# EAGLE schematic BMS-HVver3 (EAGLE 6.6.0)
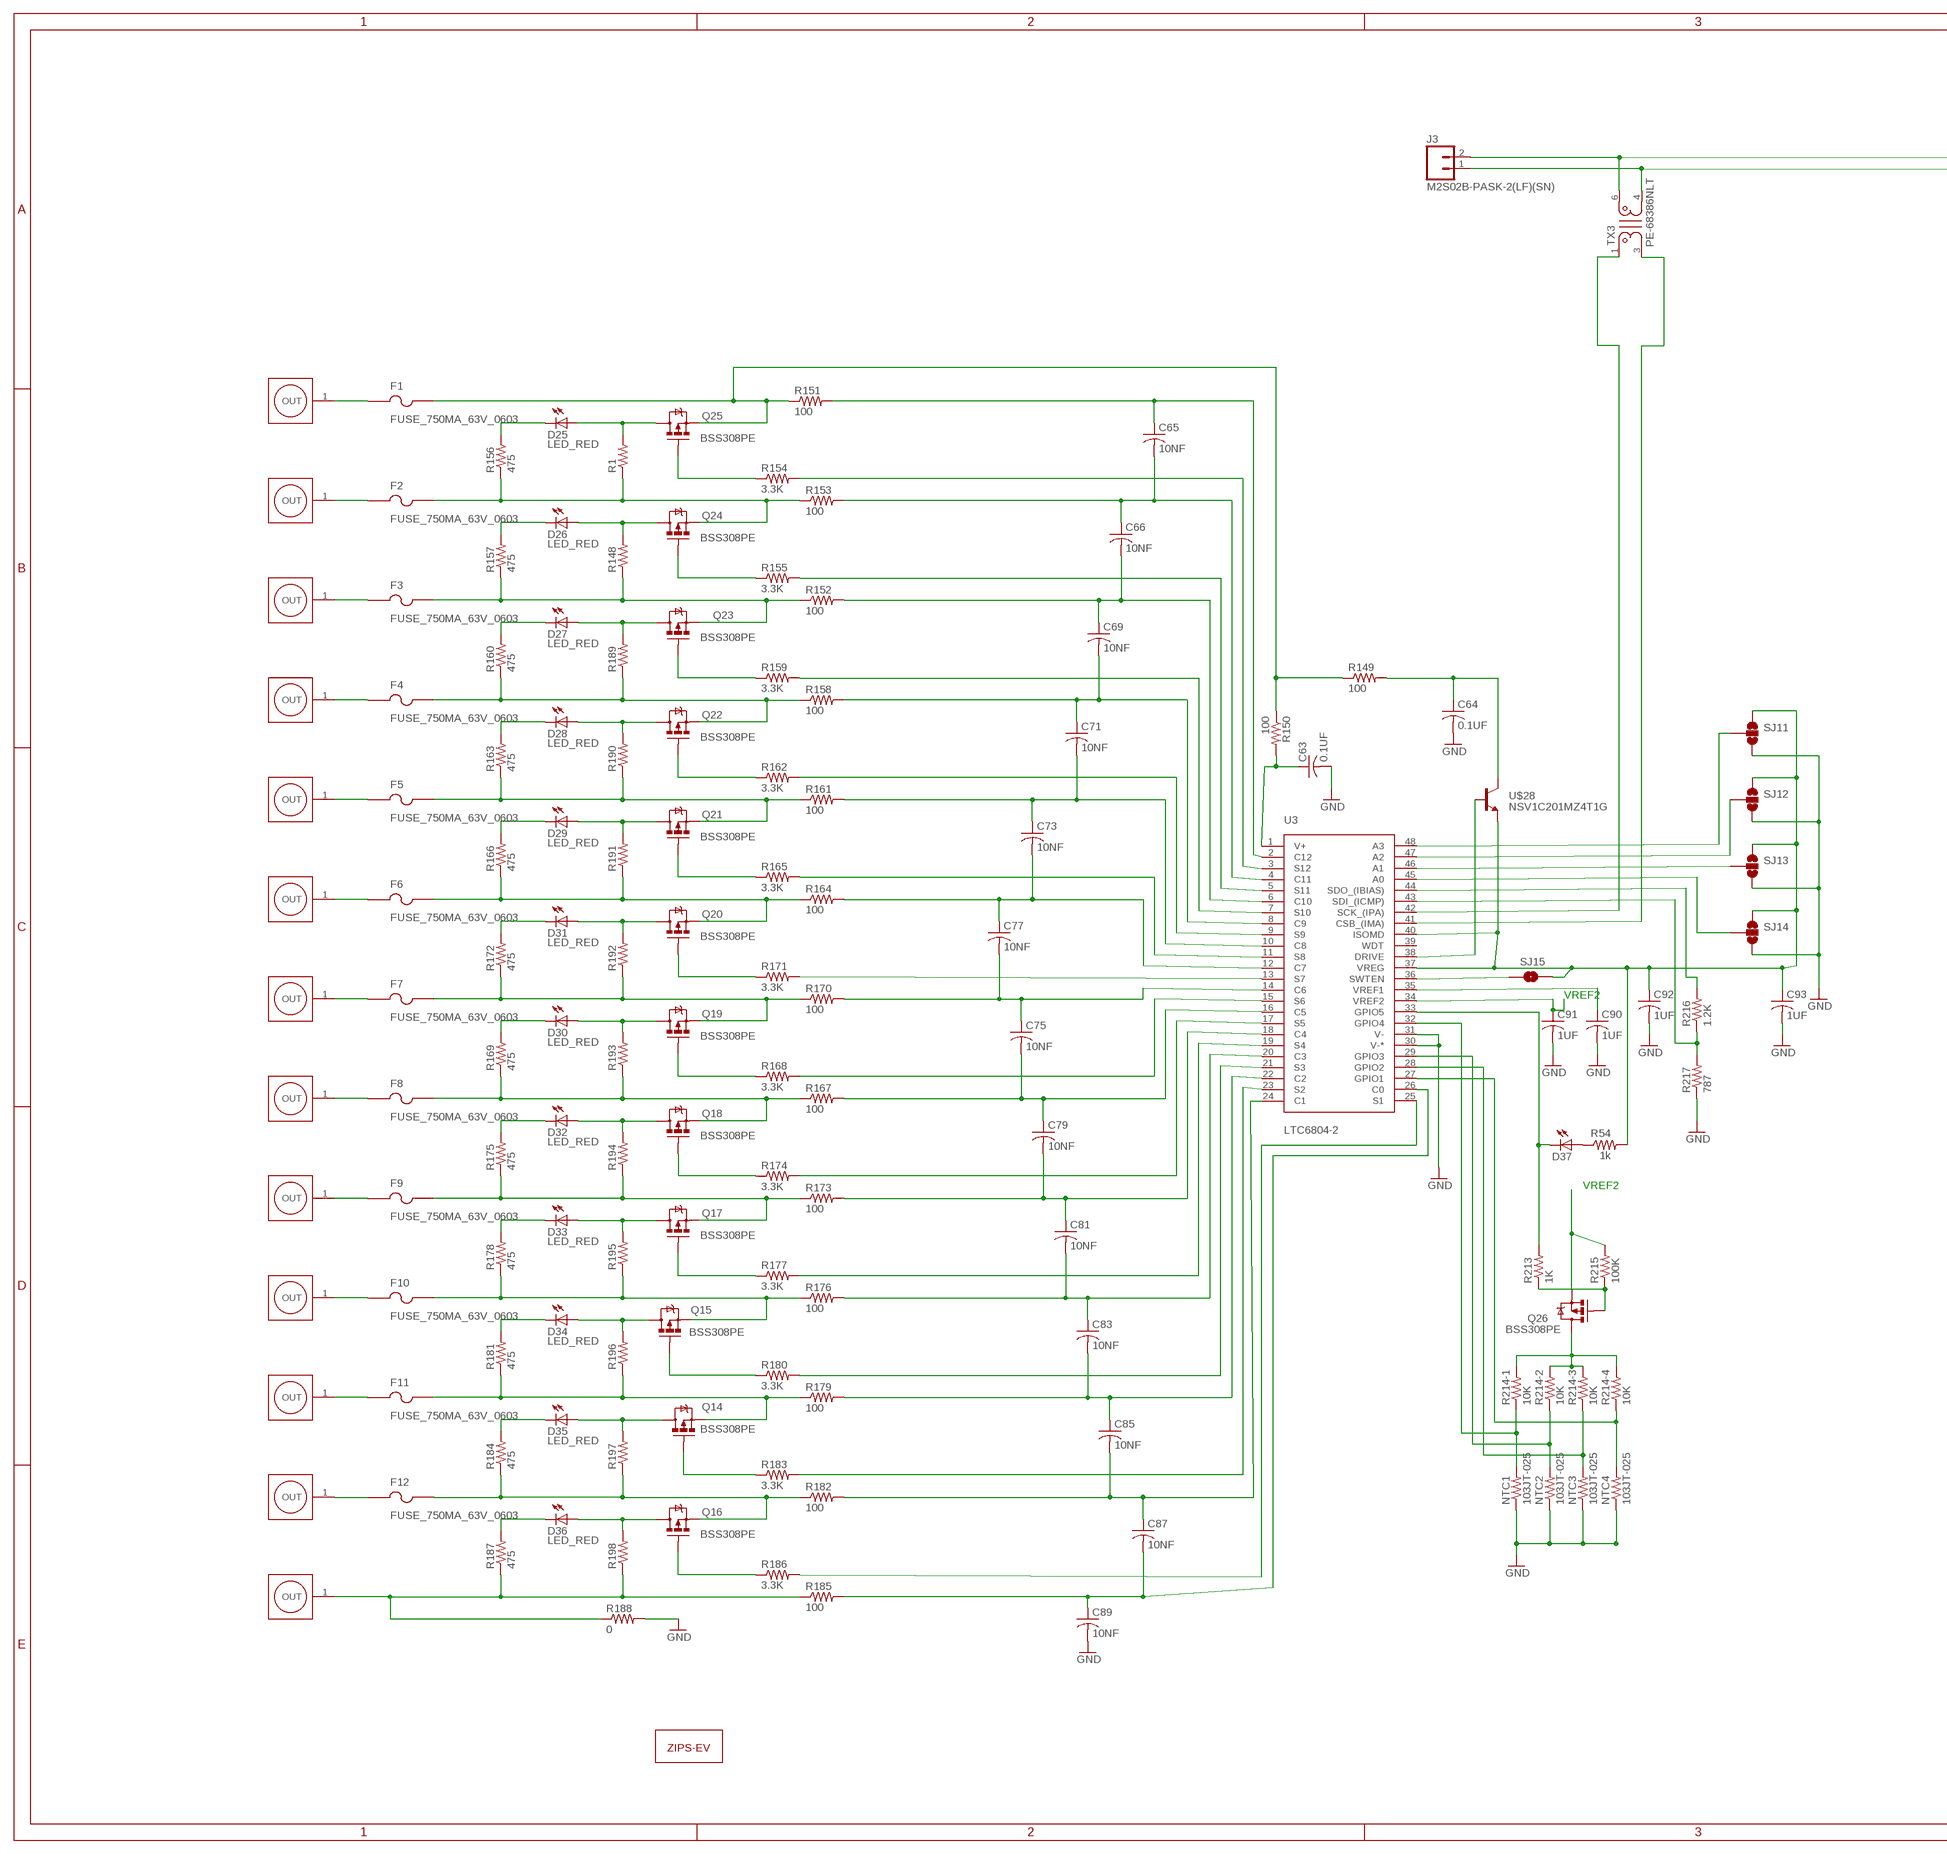
[diagram p0: schematic, sheet 1, part 1 of 3]
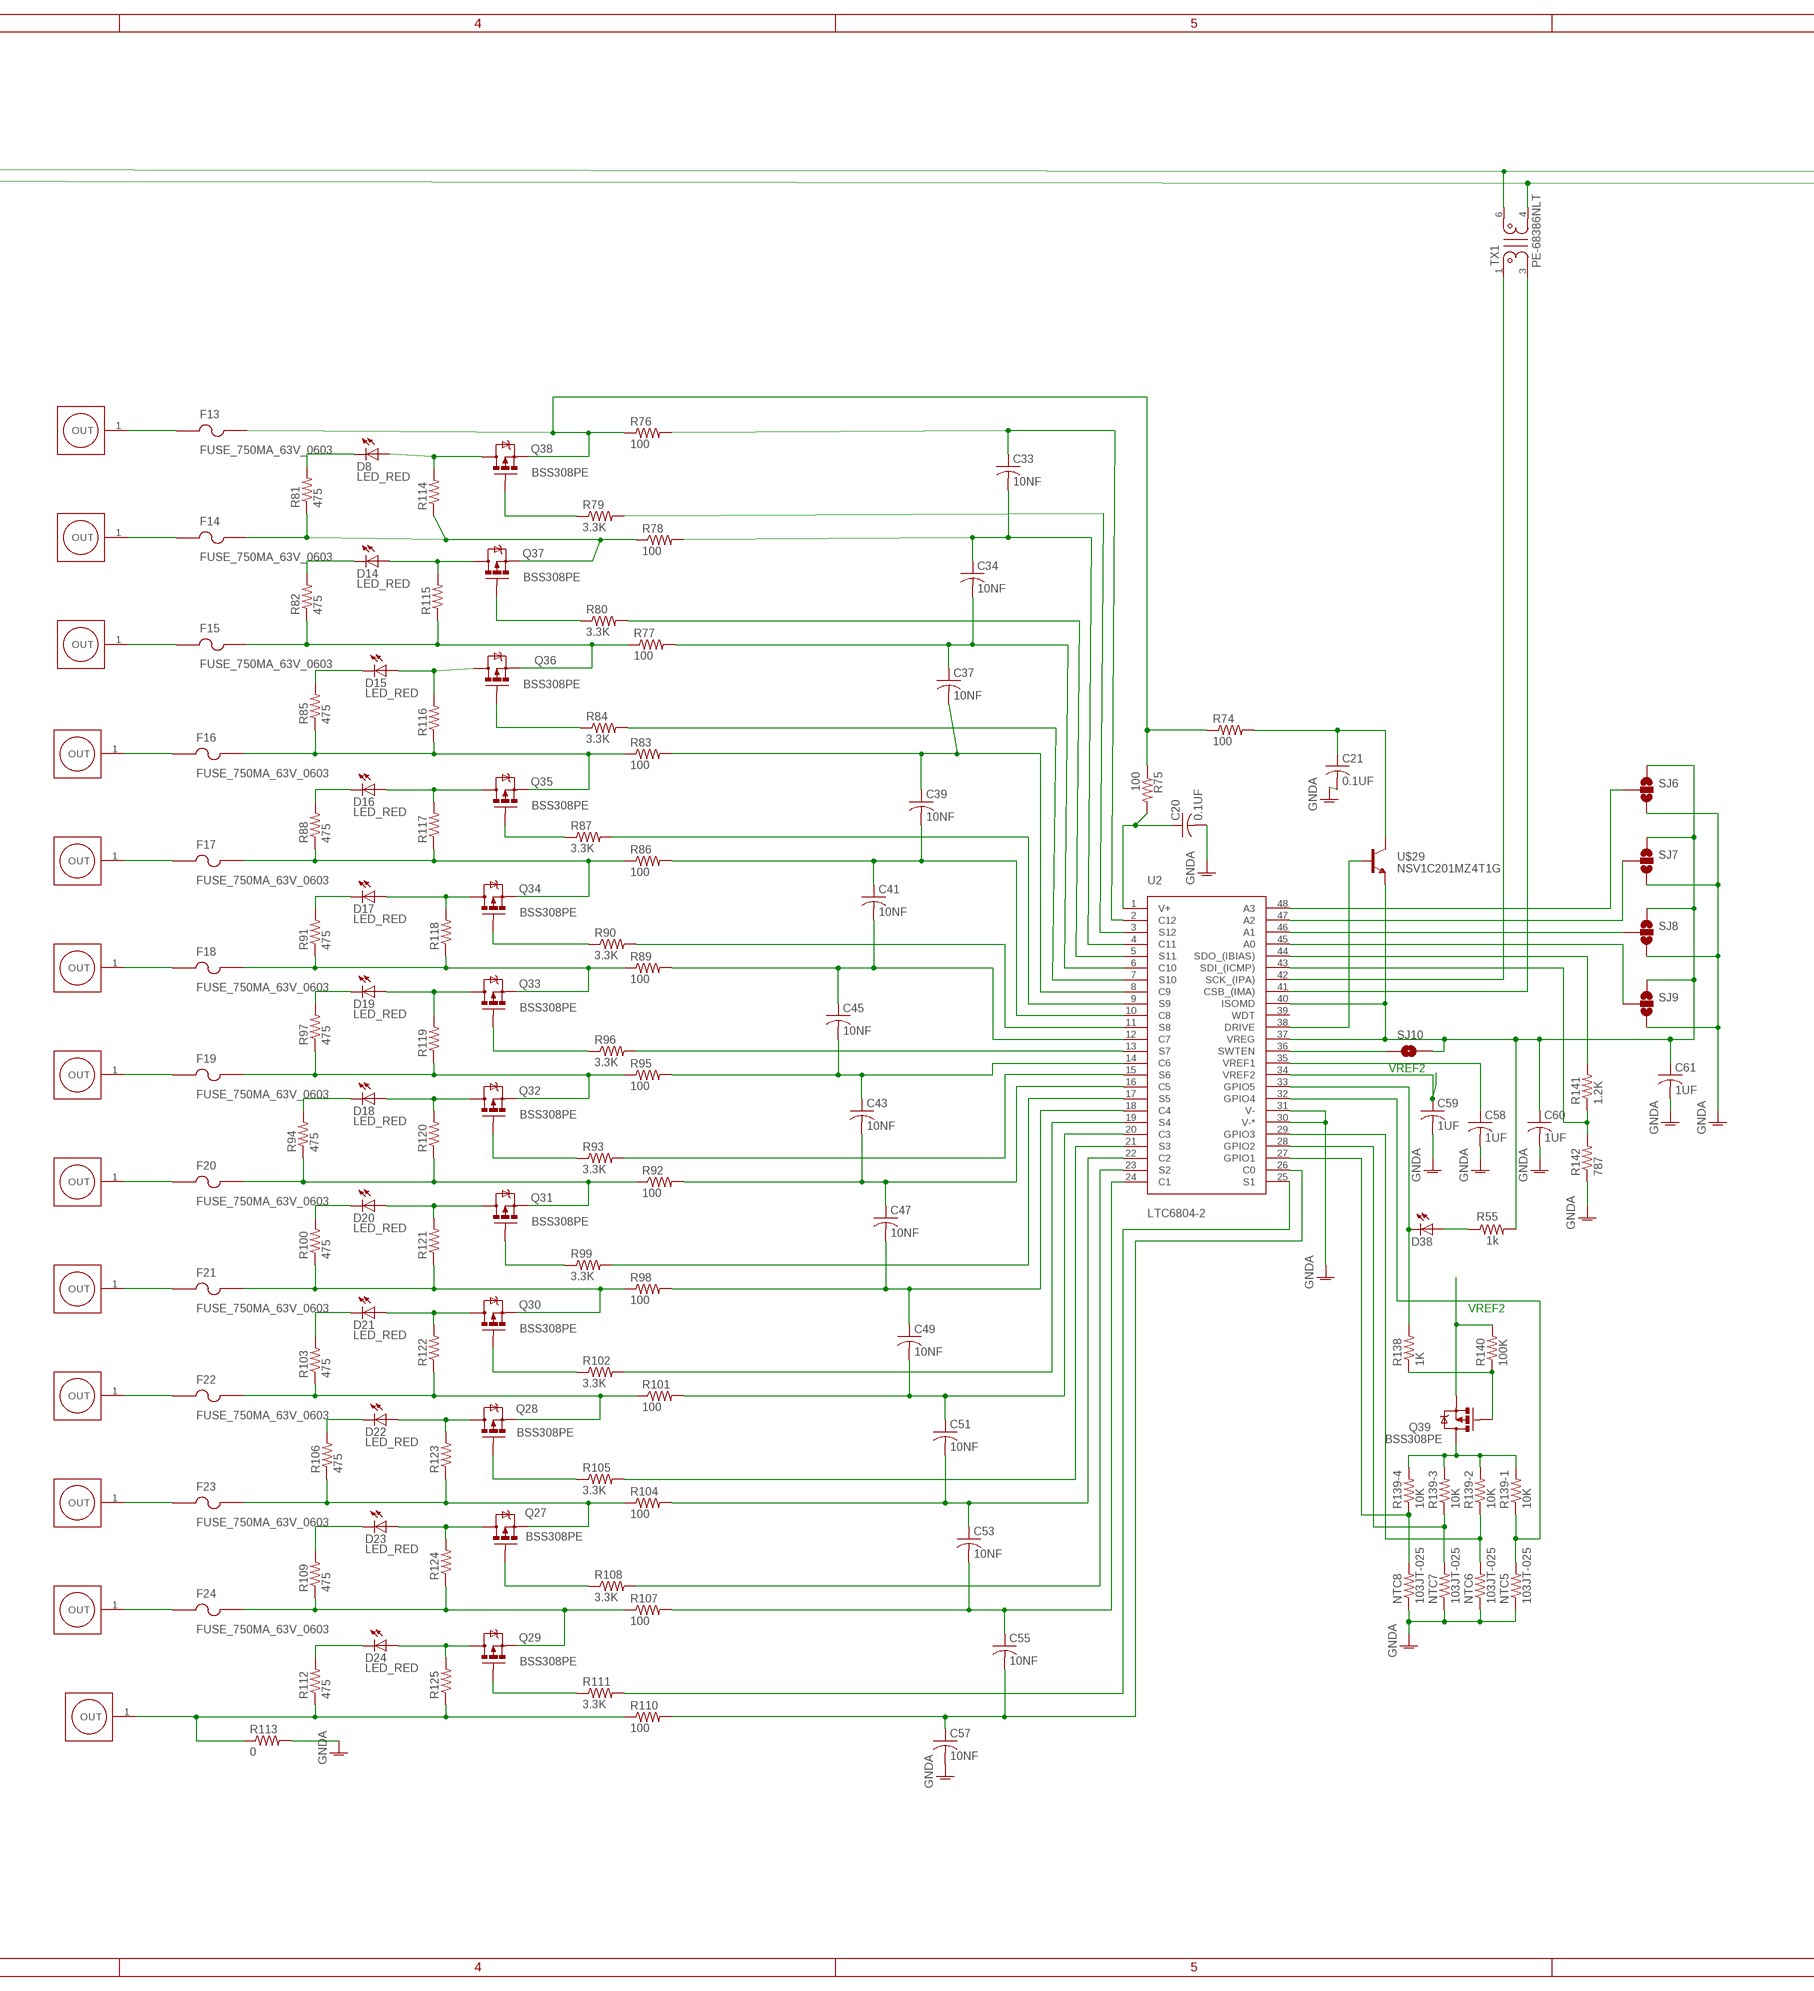
[diagram p1: schematic, sheet 1, part 2 of 3]
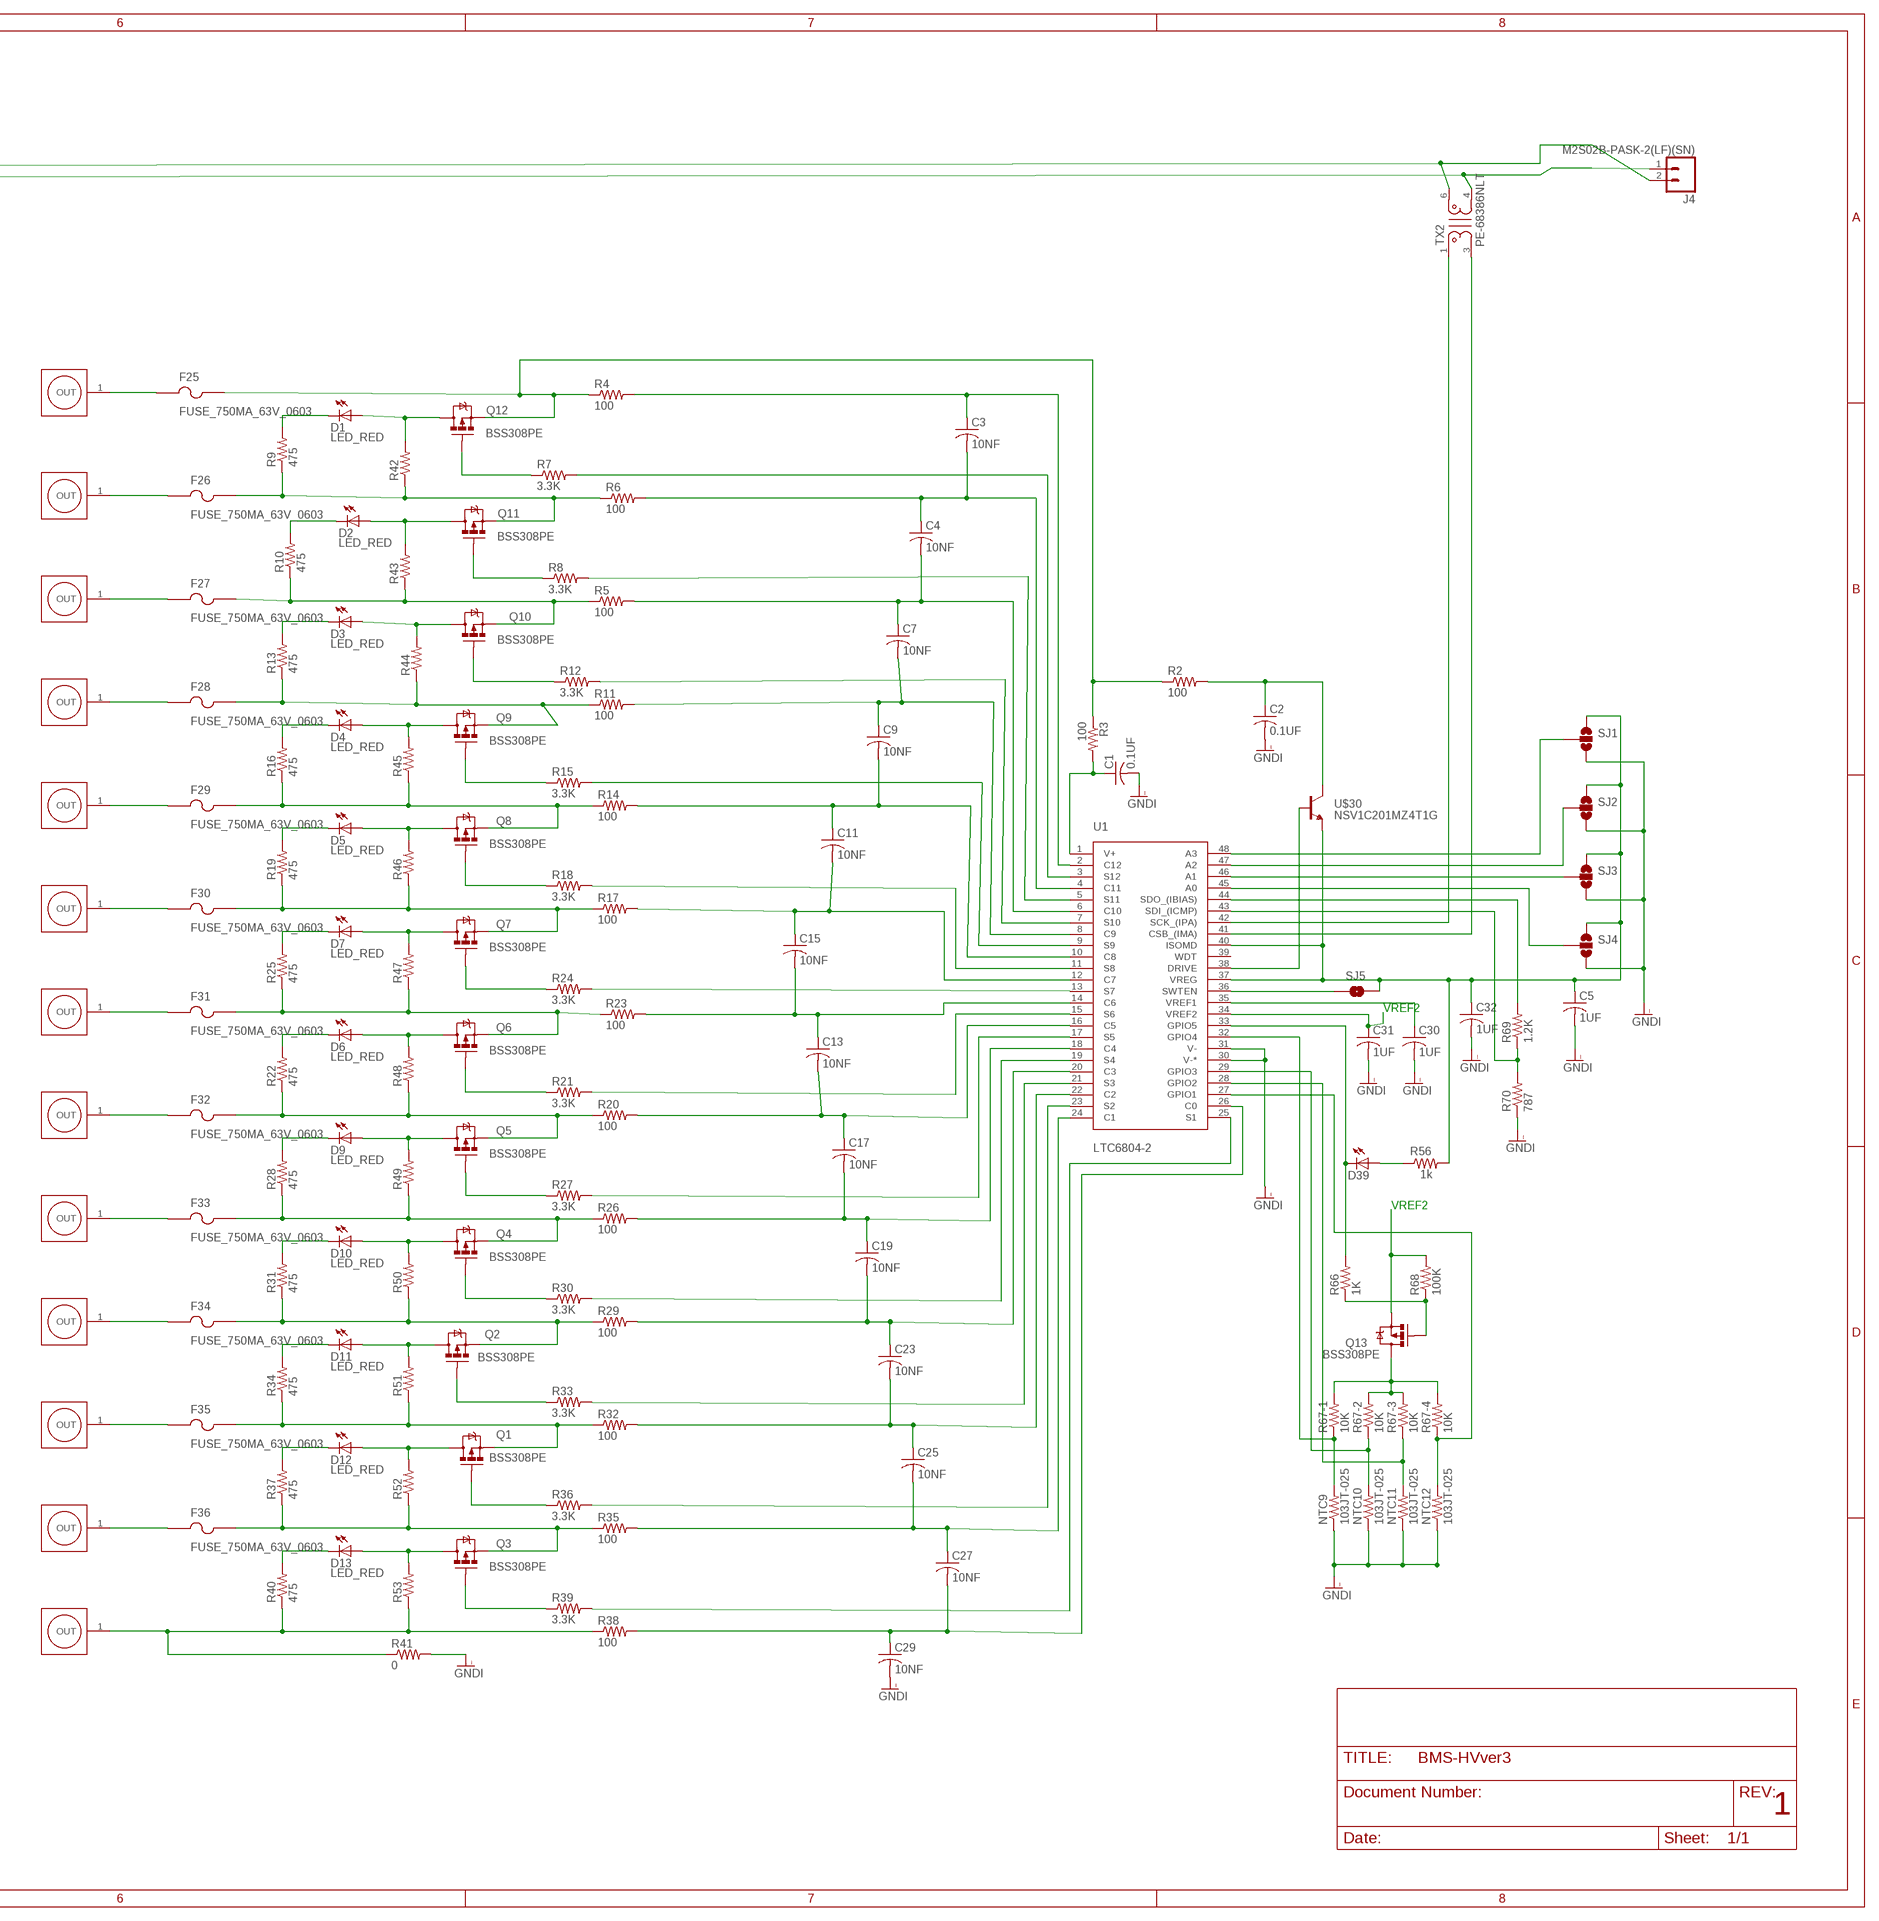
[diagram p2: schematic, sheet 1, part 3 of 3]

## Parts
C1  0.1UF  CAP_0.1UF_100V  [0805]
C2  0.1UF  CAP_0.1UF_100V  [0805]
C3  10NF  CAP_10NF_100V  [0603]
C4  10NF  CAP_10NF_100V  [0603]
C5  1UF  CAP_1UF_50V_0805  [0805]
C7  10NF  CAP_10NF_100V  [0603]
C9  10NF  CAP_10NF_100V  [0603]
C11  10NF  CAP_10NF_100V  [0603]
C13  10NF  CAP_10NF_100V  [0603]
C15  10NF  CAP_10NF_100V  [0603]
C17  10NF  CAP_10NF_100V  [0603]
C19  10NF  CAP_10NF_100V  [0603]
C20  0.1UF  CAP_0.1UF_100V  [0805]
C21  0.1UF  CAP_0.1UF_100V  [0805]
C23  10NF  CAP_10NF_100V  [0603]
C25  10NF  CAP_10NF_100V  [0603]
C27  10NF  CAP_10NF_100V  [0603]
C29  10NF  CAP_10NF_100V  [0603]
C30  1UF  CAP_1UF_50V_0805  [0805]
C31  1UF  CAP_1UF_50V_0805  [0805]
C32  1UF  CAP_1UF_50V_0805  [0805]
C33  10NF  CAP_10NF_100V  [0603]
C34  10NF  CAP_10NF_100V  [0603]
C37  10NF  CAP_10NF_100V  [0603]
C39  10NF  CAP_10NF_100V  [0603]
C41  10NF  CAP_10NF_100V  [0603]
C43  10NF  CAP_10NF_100V  [0603]
C45  10NF  CAP_10NF_100V  [0603]
C47  10NF  CAP_10NF_100V  [0603]
C49  10NF  CAP_10NF_100V  [0603]
C51  10NF  CAP_10NF_100V  [0603]
C53  10NF  CAP_10NF_100V  [0603]
C55  10NF  CAP_10NF_100V  [0603]
C57  10NF  CAP_10NF_100V  [0603]
C58  1UF  CAP_1UF_50V_0805  [0805]
C59  1UF  CAP_1UF_50V_0805  [0805]
C60  1UF  CAP_1UF_50V_0805  [0805]
C61  1UF  CAP_1UF_50V_0805  [0805]
C63  0.1UF  CAP_0.1UF_100V  [0805]
C64  0.1UF  CAP_0.1UF_100V  [0805]
C65  10NF  CAP_10NF_100V  [0603]
C66  10NF  CAP_10NF_100V  [0603]
C69  10NF  CAP_10NF_100V  [0603]
C71  10NF  CAP_10NF_100V  [0603]
C73  10NF  CAP_10NF_100V  [0603]
C75  10NF  CAP_10NF_100V  [0603]
C77  10NF  CAP_10NF_100V  [0603]
C79  10NF  CAP_10NF_100V  [0603]
C81  10NF  CAP_10NF_100V  [0603]
C83  10NF  CAP_10NF_100V  [0603]
C85  10NF  CAP_10NF_100V  [0603]
C87  10NF  CAP_10NF_100V  [0603]
C89  10NF  CAP_10NF_100V  [0603]
C90  1UF  CAP_1UF_50V_0805  [0805]
C91  1UF  CAP_1UF_50V_0805  [0805]
C92  1UF  CAP_1UF_50V_0805  [0805]
C93  1UF  CAP_1UF_50V_0805  [0805]
D1  LED_RED  [CHIP_LED0805]
D2  LED_RED  [CHIP_LED0805]
D3  LED_RED  [CHIP_LED0805]
D4  LED_RED  [CHIP_LED0805]
D5  LED_RED  [CHIP_LED0805]
D6  LED_RED  [CHIP_LED0805]
D7  LED_RED  [CHIP_LED0805]
D8  LED_RED  [CHIP_LED0805]
D9  LED_RED  [CHIP_LED0805]
D10  LED_RED  [CHIP_LED0805]
D11  LED_RED  [CHIP_LED0805]
D12  LED_RED  [CHIP_LED0805]
D13  LED_RED  [CHIP_LED0805]
D14  LED_RED  [CHIP_LED0805]
D15  LED_RED  [CHIP_LED0805]
D16  LED_RED  [CHIP_LED0805]
D17  LED_RED  [CHIP_LED0805]
D18  LED_RED  [CHIP_LED0805]
D19  LED_RED  [CHIP_LED0805]
D20  LED_RED  [CHIP_LED0805]
D21  LED_RED  [CHIP_LED0805]
D22  LED_RED  [CHIP_LED0805]
D23  LED_RED  [CHIP_LED0805]
D24  LED_RED  [CHIP_LED0805]
D25  LED_RED  [CHIP_LED0805]
D26  LED_RED  [CHIP_LED0805]
D27  LED_RED  [CHIP_LED0805]
D28  LED_RED  [CHIP_LED0805]
D29  LED_RED  [CHIP_LED0805]
D30  LED_RED  [CHIP_LED0805]
D31  LED_RED  [CHIP_LED0805]
D32  LED_RED  [CHIP_LED0805]
D33  LED_RED  [CHIP_LED0805]
D34  LED_RED  [CHIP_LED0805]
D35  LED_RED  [CHIP_LED0805]
D36  LED_RED  [CHIP_LED0805]
D37  LED_AMBER  [CHIP_LED0805]
D38  LED_AMBER  [CHIP_LED0805]
D39  LED_AMBER  [CHIP_LED0805]
F1  FUSE_750MA_63V_0603  [0603]
F2  FUSE_750MA_63V_0603  [0603]
F3  FUSE_750MA_63V_0603  [0603]
F4  FUSE_750MA_63V_0603  [0603]
F5  FUSE_750MA_63V_0603  [0603]
F6  FUSE_750MA_63V_0603  [0603]
F7  FUSE_750MA_63V_0603  [0603]
F8  FUSE_750MA_63V_0603  [0603]
F9  FUSE_750MA_63V_0603  [0603]
F10  FUSE_750MA_63V_0603  [0603]
F11  FUSE_750MA_63V_0603  [0603]
F12  FUSE_750MA_63V_0603  [0603]
F13  FUSE_750MA_63V_0603  [0603]
F14  FUSE_750MA_63V_0603  [0603]
F15  FUSE_750MA_63V_0603  [0603]
F16  FUSE_750MA_63V_0603  [0603]
F17  FUSE_750MA_63V_0603  [0603]